# EasyEDA Pro project FOX_HTOL_1.0.eprj, board PCB1 (continued)
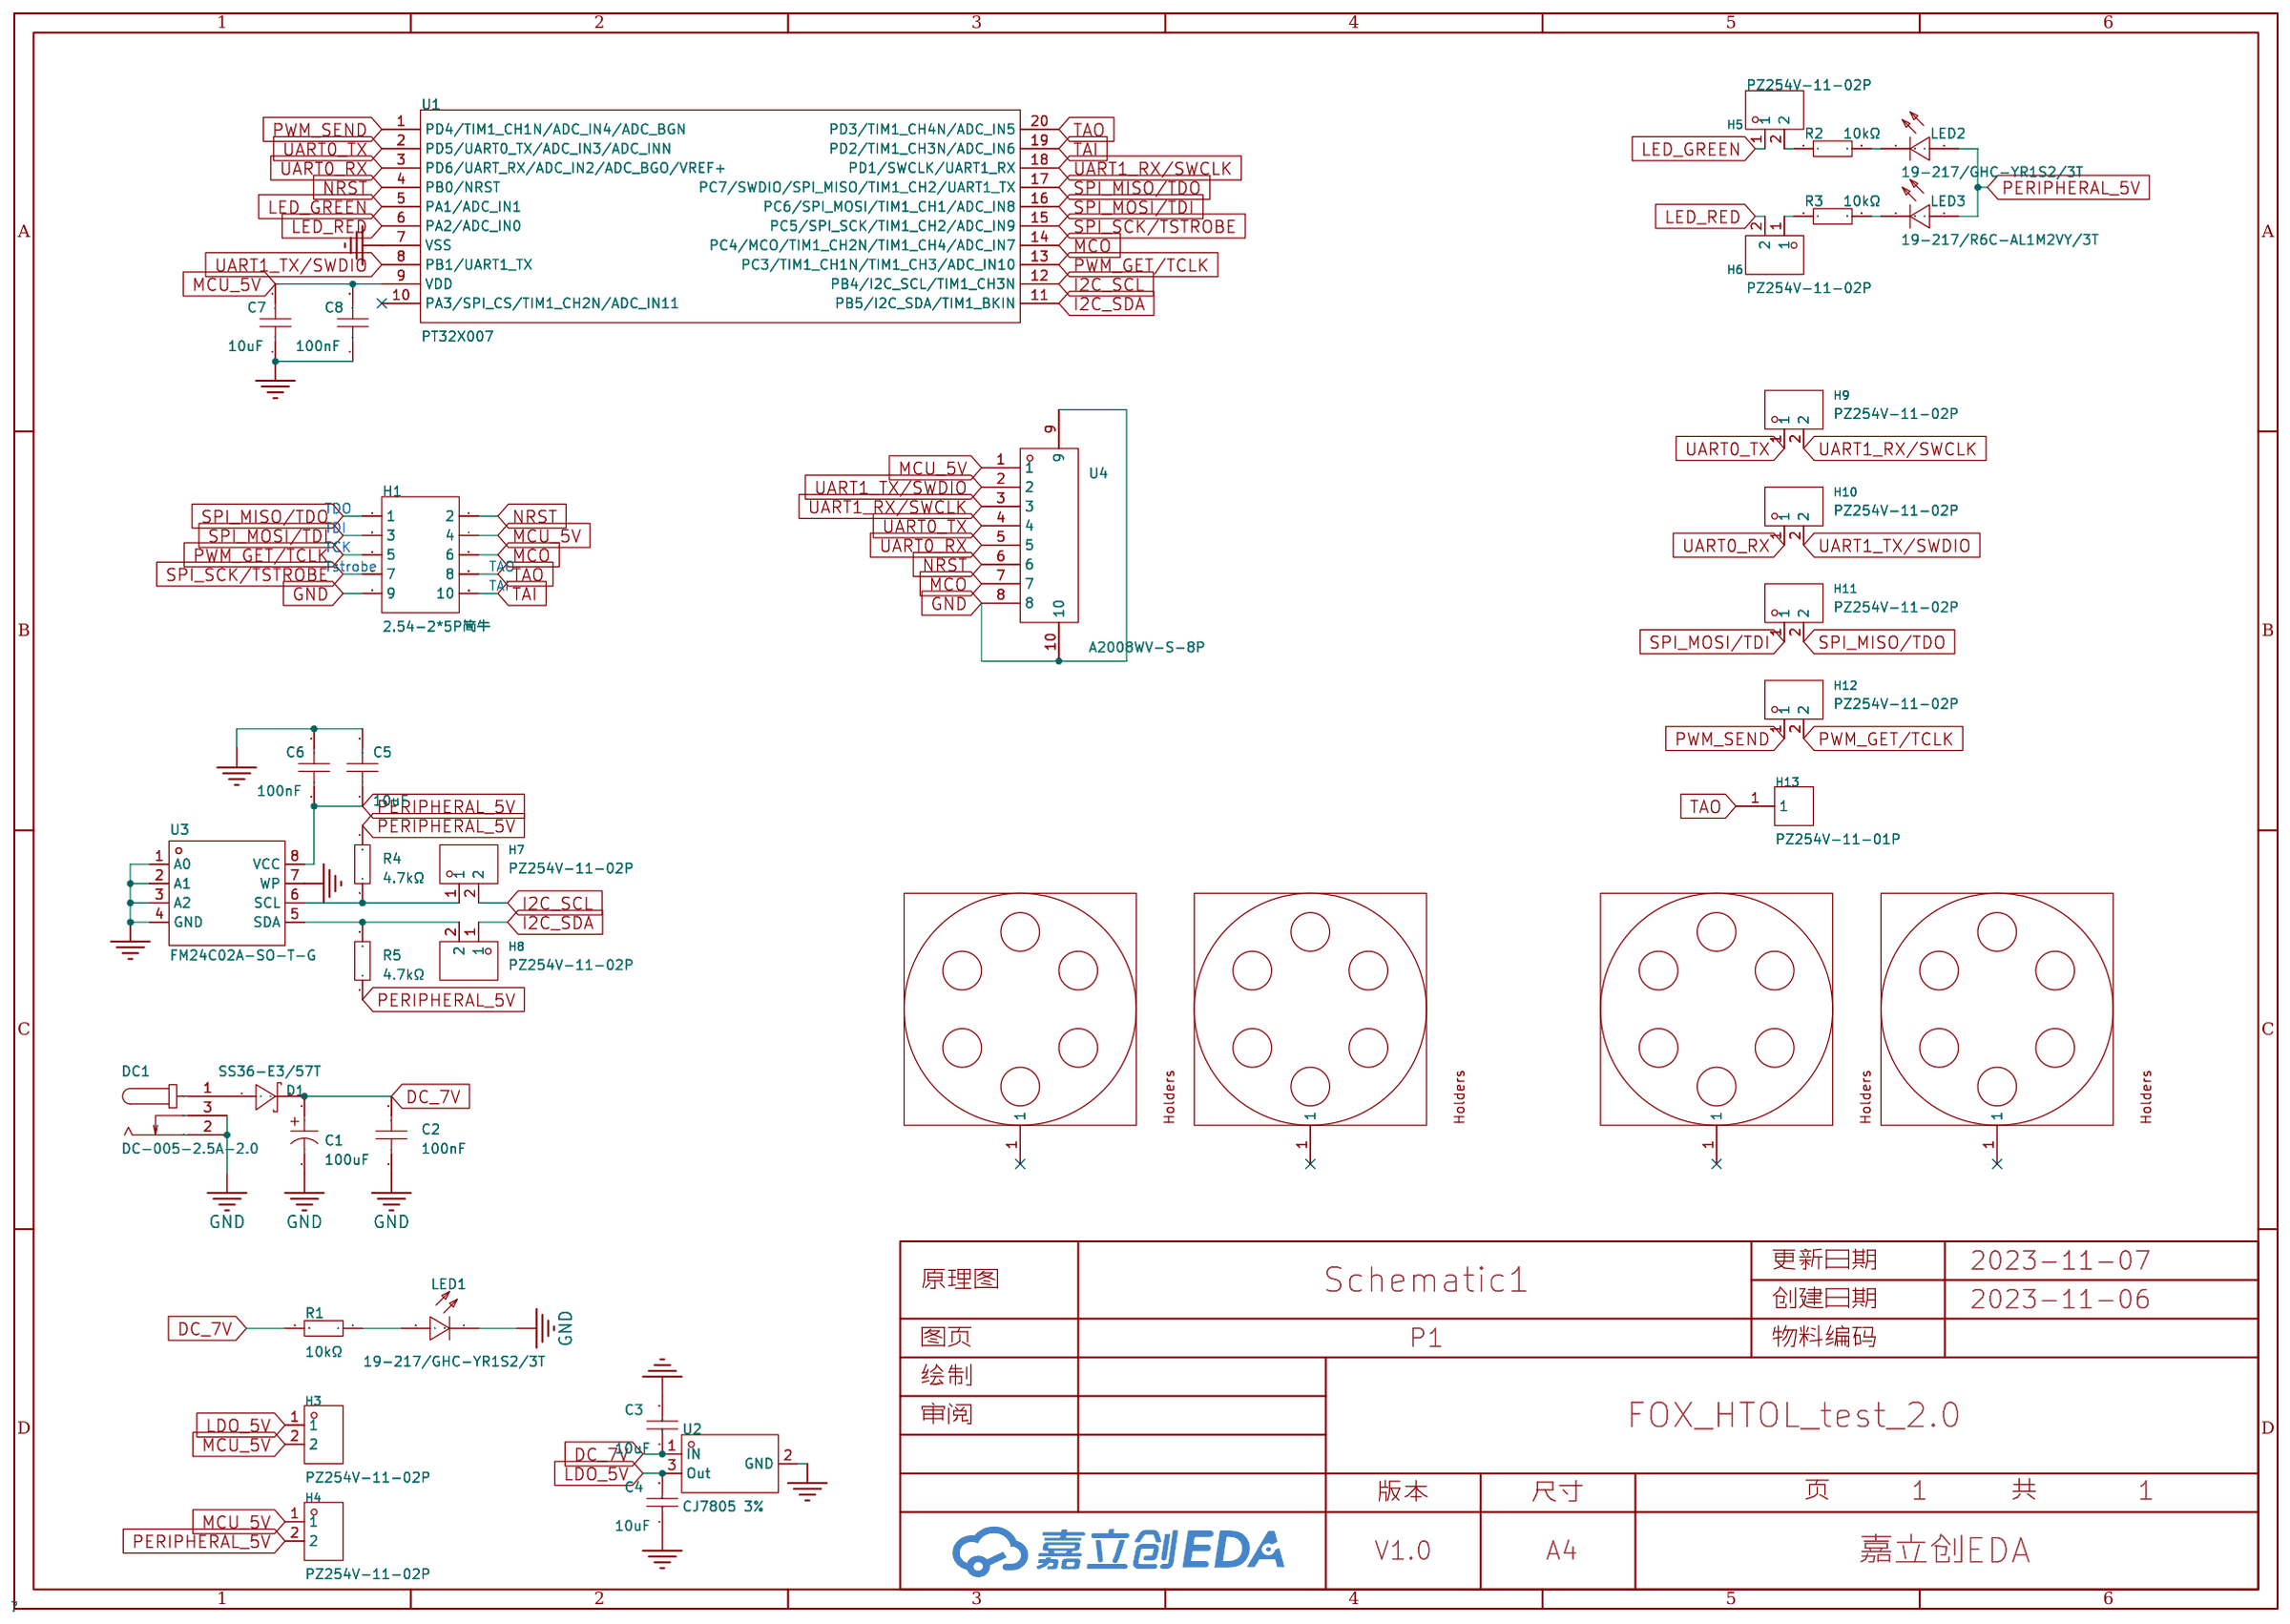
[diagram p0: schematic sheet]
## Routing (per net, layer and track width the routed paths; a pad name or vN(x,y) marks a point on that pad's centre or on a via; arc(x,y) is an arc through that point) (continued)
SPI_SCK/TSTROBE: length 354
  Top Layer w0.254: H1#16.7 21.56,157.47 21.56,152.19 22.3,151.46 U1#18.15 ; H1#6.7 98.4,189.6 98.4,184.32 99.13,183.58 U1#8.15 ; H1#4.7 98.4,253.85 98.4,248.56 99.13,247.83 U1#7.15 ; U1#26.15 60.71,22.96 59.98,23.69 59.98,28.98 H1#23.7 ; H1.7 98.4,93.23 98.4,87.94 99.13,87.21 U1#6.15 ; U1#13.15 137.54,215.71 136.81,216.44 136.81,221.72 H1#12.7 ; U1#5.15 99.13,215.71 98.4,216.44 98.4,221.72 H1#5.7 ; H1#11.7 136.81,253.85 136.81,248.56 137.54,247.83 U1#15.15 ; H1#26.7 59.98,253.85 59.98,248.56 60.71,247.83 U1#29.15 ; U1#14.15 137.54,87.21 136.81,87.94 136.81,93.23 H1#15.7 ; H1#7.7 98.4,157.47 98.4,152.19 99.13,151.46 U1#9.15 ; U1#12.15 137.54,22.96 136.81,23.69 136.81,28.98 H1#9.7 ; U1#23.15 22.3,215.71 21.56,216.44 21.56,221.72 H1#21.7 ; U1#3.15 99.13,55.09 98.4,55.82 98.4,61.1 H1#32.7 ; H1#10.7 136.81,125.35 136.81,120.07 137.54,119.33 139.2,119.33 ; U1#16.15 137.54,183.58 136.81,184.32 136.81,189.6 H1#13.7 ; H1#14.7 136.81,157.47 136.81,152.19 137.54,151.46 U1#17.15 ; U1#30.15 60.71,183.58 59.98,184.32 59.98,189.6 H1#28.7 ; H1#17.7 21.56,28.98 21.56,23.69 22.3,22.96 U1#19.15 ; U1#27.15 60.71,215.71 59.98,216.44 59.98,221.72 H1#27.7 ; U1#28.15 60.71,87.21 59.98,87.94 59.98,93.23 H1#30.7 ; U1#4.15 99.13,22.96 98.4,23.69 98.4,28.98 H1#2.7 ; H1#25.7 21.56,253.85 21.56,248.56 22.3,247.83 U1.15 ; U1#32.15 60.71,151.46 59.98,152.19 59.98,157.47 H1#29.7 ; U1#21.15 22.3,55.09 21.56,55.82 21.56,61.1 H1#19.7 ; H1#24.7 59.98,125.35 59.98,120.07 60.71,119.33 62.37,119.33 ; H1#22.7 59.98,61.1 59.98,55.82 60.71,55.09 U1#25.15 ; H1#8.7 136.81,61.1 136.81,55.82 137.54,55.09 U1#11.15 ; H1#3.7 98.4,125.35 98.4,120.07 99.13,119.33 100.78,119.33 ; H1#20.7 21.56,125.35 21.56,120.07 22.3,119.33 23.95,119.33 ; H1#31.7 21.56,189.6 21.56,184.32 22.3,183.58 U1#31.15 ; H1#18.7 21.56,93.23 21.56,87.94 22.3,87.21 U1#20.15
TAI: length 687.1
  Top Layer w0.254: U1#2.19 103,121.94 104.77,120.17 106.8,120.17 108.71,122.07 108.71,127.41 106.04,130.07 H1#3.10 ; H1#26.10 67.63,258.57 70.29,255.9 70.29,250.57 68.39,248.67 66.36,248.67 64.59,250.43 U1#29.19 ; H1#2.10 106.04,33.7 108.71,31.03 108.71,25.7 106.8,23.79 104.77,23.79 103,25.56 U1#4.19 ; U1#5.19 103,218.31 104.77,216.54 106.8,216.54 108.71,218.45 108.71,223.78 106.04,226.45 H1#5.10 ; H1#29.10 67.63,162.2 70.29,159.53 70.29,154.2 68.39,152.29 66.36,152.29 64.59,154.06 U1#32.19 ; H1#14.10 144.46,162.2 147.12,159.53 147.12,154.2 145.22,152.29 143.19,152.29 141.42,154.06 U1#17.19 ; H1#27.10 67.63,226.45 70.29,223.78 70.29,218.45 68.39,216.54 66.36,216.54 64.59,218.31 U1#27.19 ; U1.19 26.17,250.43 27.94,248.67 29.97,248.67 31.88,250.57 31.88,255.9 29.21,258.57 H1#25.10 ; H1#20.10 29.21,130.07 31.88,127.41 31.88,122.07 29.97,120.17 27.94,120.17 26.17,121.94 U1#22.19 ; H1#19.10 29.21,65.83 31.88,63.16 31.88,57.82 29.97,55.92 27.94,55.92 26.17,57.69 U1#21.19 ; H1#17.10 29.21,33.7 31.88,31.03 31.88,25.7 29.97,23.79 27.94,23.79 26.17,25.56 U1#19.19 ; H1#24.10 67.63,130.07 70.29,127.41 70.29,122.07 68.39,120.17 66.36,120.17 64.59,121.94 U1#24.19 ; U1#13.19 141.42,218.31 143.19,216.54 145.22,216.54 147.12,218.45 147.12,223.78 144.46,226.45 H1#12.10 ; U1#23.19 26.17,218.31 27.94,216.54 29.97,216.54 31.88,218.45 31.88,223.78 29.21,226.45 H1#21.10 ; 26.29,194.32 29.21,194.32 31.88,191.66 31.88,186.32 29.97,184.42 27.94,184.42 26.17,186.18 U1#31.19 ; U1#15.19 141.42,250.43 143.19,248.67 145.22,248.67 147.12,250.57 147.12,255.9 144.46,258.57 H1#11.10 ; 103.12,194.32 106.04,194.32 108.71,191.66 108.71,186.32 106.8,184.42 104.77,184.42 103,186.18 U1#8.19 ; U1#20.19 26.17,89.81 27.94,88.04 29.97,88.04 31.88,89.95 31.88,95.28 29.21,97.95 H1#18.10 ; U1#16.19 141.42,186.18 143.19,184.42 145.22,184.42 147.12,186.32 147.12,191.66 144.46,194.32 141.54,194.32 ; U1#28.19 64.59,89.81 66.36,88.04 68.39,88.04 70.29,89.95 70.29,95.28 67.63,97.95 H1#30.10 ; U1#9.19 103,154.06 104.77,152.29 106.8,152.29 108.71,154.2 108.71,159.53 106.04,162.2 H1#7.10 ; U1#18.19 26.17,154.06 27.94,152.29 29.97,152.29 31.88,154.2 31.88,159.53 29.21,162.2 H1#16.10 ; H1#32.10 106.04,65.83 108.71,63.16 108.71,57.82 106.8,55.92 104.77,55.92 103,57.69 U1#3.19 ; U1#10.19 141.42,121.94 143.19,120.17 145.22,120.17 147.12,122.07 147.12,127.41 144.46,130.07 H1#10.10 ; H1#9.10 144.46,33.7 147.12,31.03 147.12,25.7 145.22,23.79 143.19,23.79 141.42,25.56 U1#12.19 ; U1#11.19 141.42,57.69 143.19,55.92 145.22,55.92 147.12,57.82 147.12,63.16 144.46,65.83 H1#8.10 ; H1#23.10 67.63,33.7 70.29,31.03 70.29,25.7 68.39,23.79 66.36,23.79 64.59,25.56 U1#26.19 ; H1.10 106.04,97.95 108.71,95.28 108.71,89.95 106.8,88.04 104.77,88.04 103,89.81 U1#6.19 ; U1#14.19 141.42,89.81 143.19,88.04 145.22,88.04 147.12,89.95 147.12,95.28 144.46,97.95 H1#15.10 ; U1#7.19 103,250.43 104.77,248.67 106.8,248.67 108.71,250.57 108.71,255.9 106.04,258.57 H1#4.10 ; U1#25.19 64.59,57.69 66.36,55.92 68.39,55.92 70.29,57.82 70.29,63.16 67.63,65.83 H1#22.10 ; U1#30.19 64.59,186.18 66.36,184.42 68.39,184.42 70.29,186.32 70.29,191.66 67.63,194.32 64.71,194.32
TAO: length 613.9
  Top Layer w0.254: U1#20.20 28.7,90.46 H13#20.1 30.35,89.95 30.86,90.46 30.86,93.25 27.43,96.68 25.02,96.68 H1#18.8 ; U1#29.20 67.11,251.08 H13#27.1 68.77,250.57 69.28,251.08 69.28,253.87 65.85,257.3 63.44,257.3 H1#26.8 ; U1#14.20 143.95,90.46 H13#17.1 145.6,89.95 146.11,90.46 146.11,93.25 142.68,96.68 140.27,96.68 H1#15.8 ; H1#3.8 101.85,128.8 104.26,128.8 107.69,125.38 107.69,122.58 107.19,122.07 H13.1 105.53,122.59 U1#2.20 ; H1#21.8 25.02,225.18 27.43,225.18 30.86,221.75 30.86,218.95 30.35,218.45 H13#24.1 28.7,218.96 U1#23.20 ; H1#16.8 25.02,160.93 27.43,160.93 30.86,157.5 30.86,154.71 30.35,154.2 H13#18.1 28.7,154.71 U1#18.20 ; H1#7.8 101.85,160.93 104.26,160.93 107.69,157.5 107.69,154.71 107.19,154.2 H13#6.1 105.53,154.71 U1#9.20 ; U1#31.20 28.7,186.83 H13#15.1 30.35,186.32 30.86,186.83 30.86,189.62 27.43,193.05 25.02,193.05 23.75,194.32 ; H1.8 101.85,96.68 104.26,96.68 107.69,93.25 107.69,90.46 107.19,89.95 H13#8.1 105.53,90.46 U1#6.20 ; U1#7.20 105.53,251.08 H13#4.1 107.19,250.57 107.69,251.08 107.69,253.87 104.26,257.3 101.85,257.3 H1#4.8 ; 100.58,194.32 101.85,193.05 104.26,193.05 107.69,189.62 107.69,186.83 107.19,186.32 H13#7.1 105.53,186.83 U1#8.20 ; H1#10.8 140.27,128.8 142.68,128.8 146.11,125.38 146.11,122.58 145.6,122.07 H13#9.1 143.95,122.59 U1#10.20 ; U1#3.20 105.53,58.34 H13#2.1 107.19,57.82 107.69,58.33 107.69,61.13 104.26,64.56 101.85,64.56 H1#32.8 ; H1#8.8 140.27,64.56 142.68,64.56 146.11,61.13 146.11,58.33 145.6,57.82 H13#10.1 143.95,58.34 U1#11.20 ; U1#21.20 28.7,58.34 H13#21.1 30.35,57.82 30.86,58.33 30.86,61.13 27.43,64.56 25.02,64.56 H1#19.8 ; H1#29.8 63.44,160.93 65.85,160.93 69.28,157.5 69.28,154.71 68.77,154.2 H13#29.1 67.11,154.71 U1#32.20 ; U1#16.20 143.95,186.83 H13#16.1 145.6,186.32 146.11,186.83 146.11,189.62 142.68,193.05 140.27,193.05 139,194.32 ; U1#5.20 105.53,218.96 H13#5.1 107.19,218.45 107.69,218.95 107.69,221.75 104.26,225.18 101.85,225.18 H1#5.8 ; U1#13.20 143.95,218.96 H13#13.1 145.6,218.45 146.11,218.95 146.11,221.75 142.68,225.18 140.27,225.18 H1#12.8 ; H1#14.8 140.27,160.93 142.68,160.93 146.11,157.5 146.11,154.71 145.6,154.2 H13#14.1 143.95,154.71 U1#17.20 ; U1#25.20 67.11,58.34 H13#25.1 68.77,57.82 69.28,58.33 69.28,61.13 65.85,64.56 63.44,64.56 H1#22.8 ; H1#11.8 140.27,257.3 142.68,257.3 146.11,253.87 146.11,251.08 145.6,250.57 H13#12.1 143.95,251.08 U1#15.20 ; 62.16,194.32 63.44,193.05 65.85,193.05 69.28,189.62 69.28,186.83 68.77,186.32 H13#31.1 67.11,186.83 U1#30.20 ; U1#24.20 67.11,122.59 H13#23.1 68.77,122.07 69.28,122.58 69.28,125.38 65.85,128.8 63.44,128.8 H1#24.8 ; U1#26.20 67.11,26.21 H13#26.1 68.77,25.7 69.28,26.21 69.28,29 65.85,32.43 63.44,32.43 H1#23.8 ; H1#30.8 63.44,96.68 65.85,96.68 69.28,93.25 69.28,90.46 68.77,89.95 H13#32.1 67.11,90.46 U1#28.20 ; U1#19.20 28.7,26.21 H13#19.1 30.35,25.7 30.86,26.21 30.86,29 27.43,32.43 25.02,32.43 H1#17.8 ; H1#25.8 25.02,257.3 27.43,257.3 30.86,253.87 30.86,251.08 30.35,250.57 H13#30.1 28.7,251.08 U1.20 ; U1#22.20 28.7,122.59 H13#22.1 30.35,122.07 30.86,122.58 30.86,125.38 27.43,128.8 25.02,128.8 H1#20.8 ; U1#12.20 143.95,26.21 H13#11.1 145.6,25.7 146.11,26.21 146.11,29 142.68,32.43 140.27,32.43 H1#9.8 ; U1#4.20 105.53,26.21 H13#3.1 107.19,25.7 107.69,26.21 107.69,29 104.26,32.43 101.85,32.43 H1#2.8 ; H1#27.8 63.44,225.18 65.85,225.18 69.28,221.75 69.28,218.95 68.77,218.45 H13#28.1 67.11,218.96 U1#27.20
UART0_RX: length 1196.7
  Top Layer w0.254: U4#3.5 v1(115.4,25.7) 115.44,25.7 ; v2(96.77,151.53) 96.77,152.77 96.14,153.41 U1#9.3 89.05,153.41 88.39,154.07 88.39,158.26 87.75,158.9 H10#4.1 ; v2(135.19,247.9) 135.19,249.15 134.55,249.78 U1#15.3 127.47,249.78 126.8,250.44 126.8,254.63 126.17,255.27 H10#11.1 ; U4#26.5 v1(76.99,25.7) 77.02,25.7 ; U4#15.5 v1(153.82,250.57) 153.86,250.57 ; v2(96.77,23.03) 96.77,24.28 96.14,24.91 U1#4.3 89.05,24.91 88.39,25.57 88.39,29.76 87.75,30.4 H10#6.1 ; 38.61,122.07 v1(38.57,122.07) U4#23.5 ; v2(58.36,23.03) 58.36,24.28 57.72,24.91 U1#26.3 50.63,24.91 49.97,25.57 49.97,29.76 49.34,30.4 H10#30.1 ; 115.44,250.57 v1(115.4,250.57) U4#6.5 ; H10#10.1 126.17,126.77 126.8,126.14 126.8,121.95 127.47,121.29 U1#10.3 134.55,121.29 135.19,120.65 v2(135.19,119.41) ; 38.61,89.95 v1(38.57,89.95) U4#22.5 ; 115.44,154.2 v1(115.4,154.2) U4#5.5 ; 77.02,122.07 v1(76.99,122.07) U4#32.5 ; H10#12.1 126.17,223.15 126.8,222.51 126.8,218.32 127.47,217.66 U1#13.3 134.55,217.66 135.19,217.02 v2(135.19,215.78) ; v2(135.19,87.28) 135.19,88.53 134.55,89.16 U1#14.3 127.47,89.16 126.8,89.82 126.8,94.01 126.17,94.65 H10#17.1 ; H10#9.1 10.92,255.27 11.56,254.63 11.56,250.44 12.22,249.78 U1.3 19.3,249.78 19.94,249.15 v2(19.94,247.9) ; H10#18.1 10.92,191.02 11.56,190.39 11.56,186.19 12.22,185.53 U1#31.3 19.3,185.53 19.94,184.9 v2(19.94,183.65) ; v2(96.77,215.78) 96.77,217.02 96.14,217.66 U1#5.3 89.05,217.66 88.39,218.32 88.39,222.51 87.75,223.15 H10#3.1 ; H10#27.1 10.92,223.15 11.56,222.51 11.56,218.32 12.22,217.66 U1#23.3 19.3,217.66 19.94,217.02 v2(19.94,215.78) ; v2(96.77,87.28) 96.77,88.53 96.14,89.16 U1#6.3 89.05,89.16 88.39,89.82 88.39,94.01 87.75,94.65 H10#8.1 ; v2(58.36,151.53) 58.36,152.77 57.72,153.41 U1#32.3 50.63,153.41 49.97,154.07 49.97,158.26 49.34,158.9 H10#28.1 ; 153.86,186.32 v1(153.82,186.32) U4#13.5 ; v2(96.77,119.41) 96.77,120.65 96.14,121.29 U1#2.3 89.05,121.29 88.39,121.95 88.39,126.14 87.75,126.77 H10.1 ; 115.44,89.95 v1(115.4,89.95) U4.5 ; 115.44,122.07 v1(115.4,122.07) U4#8.5 ; v2(58.36,87.28) 58.36,88.53 57.72,89.16 U1#28.3 50.63,89.16 49.97,89.82 49.97,94.01 49.34,94.65 H10#32.1 ; 153.86,122.07 v1(153.82,122.07) U4#17.5 ; H10#31.1 49.34,191.02 49.97,190.39 49.97,186.19 50.63,185.53 U1#30.3 57.72,185.53 58.36,184.9 v2(58.36,183.65) ; 115.44,218.45 v1(115.4,218.45) U4#7.5 ; 153.86,57.82 v1(153.82,57.82) U4#11.5 ; H10#14.1 126.17,62.52 126.8,61.89 126.8,57.7 127.47,57.04 U1#11.3 134.55,57.04 135.19,56.4 v2(135.19,55.16) ; U4#28.5 v1(76.99,154.2) 77.02,154.2 ; 115.44,186.32 v1(115.4,186.32) U4#4.5 ; U4#12.5 v1(153.82,25.7) 153.86,25.7 ; U4#18.5 v1(38.57,186.32) 38.61,186.32 ; H10#2.1 87.75,255.27 88.39,254.63 88.39,250.44 89.05,249.78 U1#7.3 96.14,249.78 96.77,249.15 v2(96.77,247.9) ; v2(19.94,23.03) 19.94,24.28 19.3,24.91 U1#19.3 12.22,24.91 11.56,25.57 11.56,29.76 10.92,30.4 H10#20.1 ; 38.61,25.7 v1(38.57,25.7) U4#20.5 ; U4#16.5 v1(153.82,218.45) 153.86,218.45 ; U4#27.5 v1(76.99,186.32) 77.02,186.32 ; H10#23.1 10.92,126.77 11.56,126.14 11.56,121.95 12.22,121.29 U1#22.3 19.3,121.29 19.94,120.65 v2(19.94,119.41) ; 115.44,57.82 v1(115.4,57.82) U4#2.5 ; v2(58.36,119.41) 58.36,120.65 57.72,121.29 U1#24.3 50.63,121.29 49.97,121.95 49.97,126.14 49.34,126.77 H10#24.1 ; v2(96.77,183.65) 96.77,184.9 96.14,185.53 U1#8.3 89.05,185.53 88.39,186.19 88.39,190.39 87.75,191.02 H10#7.1 ; 153.86,89.95 v1(153.82,89.95) U4#10.5 ; 77.02,218.45 v1(76.99,218.45) U4#30.5 ; U4#29.5 v1(76.99,250.57) 77.02,250.57 ; H10#13.1 126.17,158.9 126.8,158.26 126.8,154.07 127.47,153.41 U1#17.3 134.55,153.41 135.19,152.77 v2(135.19,151.53) ; H10#25.1 49.34,255.27 49.97,254.63 49.97,250.44 50.63,249.78 U1#29.3 57.72,249.78 58.36,249.15 v2(58.36,247.9) ; 77.02,57.82 v1(76.99,57.82) U4#25.5 ; 153.86,154.2 v1(153.82,154.2) U4#14.5 ; H10#19.1 10.92,158.9 11.56,158.26 11.56,154.07 12.22,153.41 U1#18.3 19.3,153.41 19.94,152.77 v2(19.94,151.53) ; H10#15.1 126.17,30.4 126.8,29.76 126.8,25.57 127.47,24.91 U1#12.3 134.55,24.91 135.19,24.28 v2(135.19,23.03) ; v2(19.94,55.16) 19.94,56.4 19.3,57.04 U1#21.3 12.22,57.04 11.56,57.7 11.56,61.89 10.92,62.52 H10#22.1 ; 38.61,57.82 v1(38.57,57.82) U4#21.5 ; H10#5.1 87.75,62.52 88.39,61.89 88.39,57.7 89.05,57.04 U1#3.3 96.14,57.04 96.77,56.4 v2(96.77,55.16) ; 38.61,218.45 v1(38.57,218.45) U4#31.5 ; v2(58.36,215.78) 58.36,217.02 57.72,217.66 U1#27.3 50.63,217.66 49.97,218.32 49.97,222.51 49.34,223.15 H10#26.1 ; U4#19.5 v1(38.57,154.2) 38.61,154.2 ; H10#16.1 126.17,191.02 126.8,190.39 126.8,186.19 127.47,185.53 U1#16.3 134.55,185.53 135.19,184.9 v2(135.19,183.65) ; H10#21.1 10.92,94.65 11.56,94.01 11.56,89.82 12.22,89.16 U1#20.3 19.3,89.16 19.94,88.53 v2(19.94,87.28) ; 38.61,250.57 v1(38.57,250.57) U4#9.5 ; v2(58.36,55.16) 58.36,56.4 57.72,57.04 U1#25.3 50.63,57.04 49.97,57.7 49.97,61.89 49.34,62.52 H10#29.1 ; U4#24.5 v1(76.99,89.95) 77.02,89.95
  Bottom Layer w0.254: v2(19.94,119.41) 20.32,119.03 31.12,119.03 34.16,122.07 v1(38.57,122.07) ; v1(76.99,250.57) 72.58,250.57 69.53,247.52 58.74,247.52 v2(58.36,247.9) ; v1(76.99,122.07) 72.58,122.07 69.53,119.03 58.74,119.03 v2(58.36,119.41) ; v2(58.36,183.65) 58.74,183.27 69.53,183.27 72.58,186.32 v1(76.99,186.32) ; v1(153.82,250.57) 149.41,250.57 146.36,247.52 135.57,247.52 v2(135.19,247.9) ; v2(96.77,215.78) 97.15,215.4 107.95,215.4 111,218.45 v1(115.4,218.45) ; v2(58.36,55.16) 58.74,54.78 69.53,54.78 72.58,57.82 v1(76.99,57.82) ; v2(96.77,23.03) 97.15,22.65 107.95,22.65 111,25.7 v1(115.4,25.7) ; v2(96.77,55.16) 97.15,54.78 107.95,54.78 111,57.82 v1(115.4,57.82) ; v1(153.82,89.95) 149.41,89.95 146.36,86.9 135.57,86.9 v2(135.19,87.28) ; v2(19.94,151.53) 20.32,151.15 31.12,151.15 34.16,154.2 v1(38.57,154.2) ; v1(76.99,89.95) 72.58,89.95 69.53,86.9 58.74,86.9 v2(58.36,87.28) ; v1(38.57,25.7) 34.16,25.7 31.12,22.65 20.32,22.65 v2(19.94,23.03) ; v1(115.4,122.07) 111,122.07 107.95,119.03 97.15,119.03 v2(96.77,119.41) ; v2(135.19,183.65) 135.57,183.27 146.36,183.27 149.41,186.32 v1(153.82,186.32) ; v1(38.57,57.82) 34.16,57.82 31.12,54.78 20.32,54.78 v2(19.94,55.16) ; v2(96.77,183.65) 97.15,183.27 107.95,183.27 111,186.32 v1(115.4,186.32) ; v1(38.57,186.32) 34.16,186.32 31.12,183.27 20.32,183.27 v2(19.94,183.65) ; v2(19.94,87.28) 20.32,86.9 31.12,86.9 34.16,89.95 v1(38.57,89.95) ; v2(96.77,87.28) 97.15,86.9 107.95,86.9 111,89.95 v1(115.4,89.95) ; v2(58.36,151.53) 58.74,151.15 69.53,151.15 72.58,154.2 v1(76.99,154.2) ; v1(153.82,122.07) 149.41,122.07 146.36,119.03 135.57,119.03 v2(135.19,119.41) ; v1(38.57,250.57) 34.16,250.57 31.12,247.52 20.32,247.52 v2(19.94,247.9) ; v2(19.94,215.78) 20.32,215.4 31.12,215.4 34.16,218.45 v1(38.57,218.45) ; v2(135.19,23.03) 135.57,22.65 146.36,22.65 149.41,25.7 v1(153.82,25.7) ; v2(96.77,151.53) 97.15,151.15 107.95,151.15 111,154.2 v1(115.4,154.2) ; v1(153.82,57.82) 149.41,57.82 146.36,54.78 135.57,54.78 v2(135.19,55.16) ; v2(96.77,247.9) 97.15,247.52 107.95,247.52 111,250.57 v1(115.4,250.57) ; v2(135.19,151.53) 135.57,151.15 146.36,151.15 149.41,154.2 v1(153.82,154.2) ; v2(135.19,215.78) 135.57,215.4 146.36,215.4 149.41,218.45 v1(153.82,218.45) ; v1(76.99,25.7) 72.58,25.7 69.53,22.65 58.74,22.65 v2(58.36,23.03) ; v2(58.36,215.78) 58.74,215.4 69.53,215.4 72.58,218.45 v1(76.99,218.45)
UART0_TX: length 1278.6
  Top Layer w0.254: v1(76.97,91.96) 76.99,91.98 77.02,91.98 ; H9#14.1 126.93,161.44 127.41,160.95 127.41,154.6 127.95,154.07 133.45,154.07 U1#17.2 134.8,154.06 v2(134.81,154.07) ; 38.61,156.23 38.57,156.23 v1(38.55,156.21) ; v2(19.56,250.44) 19.55,250.43 U1.2 18.2,250.44 12.7,250.44 12.17,250.98 12.17,257.33 11.68,257.81 H9#10.1 ; v1(115.39,91.96) 115.4,91.98 115.44,91.98 ; v1(153.8,124.09) 153.82,124.11 153.86,124.11 ; v1(115.39,252.59) 115.4,252.6 115.44,252.6 ; v1(115.39,188.34) 115.4,188.35 115.44,188.35 ; v1(38.55,91.96) 38.57,91.98 38.61,91.98 ; 77.02,156.23 76.99,156.23 v1(76.97,156.21) ; 77.02,252.6 76.99,252.6 v1(76.97,252.59) ; 77.02,188.35 76.99,188.35 v1(76.97,188.34) ; v1(115.39,59.84) 115.4,59.86 115.44,59.86 ; H9#12.1 126.93,225.69 127.41,225.2 127.41,218.85 127.95,218.32 133.45,218.32 U1#13.2 134.8,218.31 v2(134.81,218.32) ; 153.86,156.23 153.82,156.23 v1(153.8,156.21) ; v1(115.39,220.46) 115.4,220.48 115.44,220.48 ; v2(57.97,218.32) 57.96,218.31 U1#27.2 56.62,218.32 51.12,218.32 50.58,218.85 50.58,225.2 50.1,225.69 H9#25.1 ; 38.61,124.11 38.57,124.11 v1(38.55,124.09) ; H9#20.1 11.68,32.94 12.17,32.46 12.17,26.11 12.7,25.57 18.2,25.57 U1#19.2 19.55,25.56 v2(19.56,25.57) ; v1(38.55,59.84) 38.57,59.86 38.61,59.86 ; v2(96.39,218.32) 96.38,218.31 U1#5.2 95.03,218.32 89.53,218.32 89,218.85 89,225.2 88.52,225.69 H9#3.1 ; v2(96.39,57.7) 96.38,57.69 U1#3.2 95.03,57.7 89.53,57.7 89,58.23 89,64.58 88.52,65.06 H9#8.1 ; v2(96.39,250.44) 96.38,250.43 U1#7.2 95.03,250.44 89.53,250.44 89,250.98 89,257.33 88.52,257.81 H9#5.1 ; 153.86,27.73 153.82,27.73 v1(153.8,27.72) ; v2(57.97,154.07) 57.96,154.06 U1#32.2 56.62,154.07 51.12,154.07 50.58,154.6 50.58,160.95 50.1,161.44 H9#29.1 ; 153.86,188.35 153.82,188.35 v1(153.8,188.34) ; H9.1 126.93,32.94 127.41,32.46 127.41,26.11 127.95,25.57 133.45,25.57 U1#12.2 134.8,25.56 v2(134.81,25.57) ; v2(96.39,121.95) 96.38,121.94 U1#2.2 95.03,121.95 89.53,121.95 89,122.48 89,128.83 88.52,129.31 H9#2.1 ; 38.61,252.6 38.57,252.6 v1(38.55,252.59) ; v2(57.97,25.57) 57.96,25.56 U1#26.2 56.62,25.57 51.12,25.57 50.58,26.11 50.58,32.46 50.1,32.94 H9#26.1 ; v1(76.97,59.84) 76.99,59.86 77.02,59.86 ; v1(76.97,124.09) 76.99,124.11 77.02,124.11 ; H9#11.1 126.93,129.31 127.41,128.83 127.41,122.48 127.95,121.95 133.45,121.95 U1#10.2 134.8,121.94 v2(134.81,121.95) ; v1(115.39,124.09) 115.4,124.11 115.44,124.11 ; H9#17.1 126.93,193.56 127.41,193.08 127.41,186.73 127.95,186.19 133.45,186.19 U1#16.2 134.8,186.18 v2(134.81,186.19) ; v1(76.97,27.72) 76.99,27.73 77.02,27.73 ; v1(115.39,156.21) 115.4,156.23 115.44,156.23 ; v1(153.8,220.46) 153.82,220.48 153.86,220.48 ; 38.61,220.48 38.57,220.48 v1(38.55,220.46) ; v2(57.97,89.82) 57.96,89.81 U1#28.2 56.62,89.82 51.12,89.82 50.58,90.36 50.58,96.71 50.1,97.19 H9#30.1 ; v1(38.55,188.34) 38.57,188.35 38.61,188.35 ; 77.02,220.48 76.99,220.48 v1(76.97,220.46) ; H9#13.1 126.93,257.81 127.41,257.33 127.41,250.98 127.95,250.44 133.45,250.44 U1#15.2 134.8,250.43 v2(134.81,250.44) ; v1(153.8,252.59) 153.82,252.6 153.86,252.6 ; v2(57.97,186.19) 57.96,186.18 U1#30.2 56.62,186.19 51.12,186.19 50.58,186.73 50.58,193.08 50.1,193.56 H9#32.1 ; H9#31.1 50.1,65.06 50.58,64.58 50.58,58.23 51.12,57.7 56.62,57.7 U1#25.2 57.96,57.69 v2(57.97,57.7) ; v1(115.39,27.72) 115.4,27.73 115.44,27.73 ; v2(96.39,25.57) 96.38,25.56 U1#4.2 95.03,25.57 89.53,25.57 89,26.11 89,32.46 88.52,32.94 H9#4.1 ; v1(38.55,27.72) 38.57,27.73 38.61,27.73 ; v2(57.97,250.44) 57.96,250.43 U1#29.2 56.62,250.44 51.12,250.44 50.58,250.98 50.58,257.33 50.1,257.81 H9#27.1 ; v1(153.8,91.96) 153.82,91.98 153.86,91.98 ; H9#23.1 11.68,129.31 12.17,128.83 12.17,122.48 12.7,121.95 18.2,121.95 U1#22.2 19.55,121.94 v2(19.56,121.95) ; H9#28.1 11.68,225.69 12.17,225.2 12.17,218.85 12.7,218.32 18.2,218.32 U1#23.2 19.55,218.31 v2(19.56,218.32) ; H9#21.1 11.68,97.19 12.17,96.71 12.17,90.36 12.7,89.82 18.2,89.82 U1#20.2 19.55,89.81 v2(19.56,89.82) ; H9#7.1 88.52,97.19 89,96.71 89,90.36 89.53,89.82 95.03,89.82 U1#6.2 96.38,89.81 v2(96.39,89.82) ; v2(19.56,154.07) 19.55,154.06 U1#18.2 18.2,154.07 12.7,154.07 12.17,154.6 12.17,160.95 11.68,161.44 H9#19.1 ; H9#15.1 126.93,97.19 127.41,96.71 127.41,90.36 127.95,89.82 133.45,89.82 U1#14.2 134.8,89.81 v2(134.81,89.82) ; H9#18.1 11.68,193.56 12.17,193.08 12.17,186.73 12.7,186.19 18.2,186.19 U1#31.2 19.55,186.18 v2(19.56,186.19) ; v2(96.39,154.07) 96.38,154.06 U1#9.2 95.03,154.07 89.53,154.07 89,154.6 89,160.95 88.52,161.44 H9#6.1 ; H9#24.1 50.1,129.31 50.58,128.83 50.58,122.48 51.12,121.95 56.62,121.95 U1#24.2 57.96,121.94 v2(57.97,121.95) ; v2(96.39,186.19) 96.38,186.18 U1#8.2 95.03,186.19 89.53,186.19 89,186.73 89,193.08 88.52,193.56 H9#9.1 ; v2(134.81,57.7) 134.8,57.69 U1#11.2 133.45,57.7 127.95,57.7 127.41,58.23 127.41,64.58 126.93,65.06 H9#16.1 ; H9#22.1 11.68,65.06 12.17,64.58 12.17,58.23 12.7,57.7 18.2,57.7 U1#21.2 19.55,57.69 v2(19.56,57.7) ; 153.86,59.86 153.82,59.86 v1(153.8,59.84)
  Bottom Layer w0.254: v1(115.39,156.21) 111.74,156.21 107.31,151.78 97.53,151.78 96.39,152.93 v2(96.39,154.07) ; v2(57.97,186.19) 57.97,185.05 59.12,183.91 68.9,183.91 73.33,188.34 v1(76.97,188.34) ; v2(134.81,218.32) 134.81,217.18 135.95,216.03 145.73,216.03 150.16,220.46 v1(153.8,220.46) ; v1(153.8,27.72) 150.16,27.72 145.73,23.29 135.95,23.29 134.81,24.43 v2(134.81,25.57) ; v1(38.55,156.21) 34.91,156.21 30.48,151.78 20.7,151.78 19.56,152.93 v2(19.56,154.07) ; v2(19.56,121.95) 19.56,120.8 20.7,119.66 30.48,119.66 34.91,124.09 v1(38.55,124.09) ; v2(19.56,250.44) 19.56,249.3 20.7,248.16 30.48,248.16 34.91,252.59 v1(38.55,252.59) ; v1(38.55,91.96) 34.91,91.96 30.48,87.54 20.7,87.54 19.56,88.68 v2(19.56,89.82) ; v2(19.56,57.7) 19.56,56.55 20.7,55.41 30.48,55.41 34.91,59.84 v1(38.55,59.84) ; v2(57.97,154.07) 57.97,152.93 59.12,151.78 68.9,151.78 73.33,156.21 v1(76.97,156.21) ; v1(38.55,220.46) 34.91,220.46 30.48,216.03 20.7,216.03 19.56,217.18 v2(19.56,218.32) ; v2(134.81,89.82) 134.81,88.68 135.95,87.54 145.73,87.54 150.16,91.96 v1(153.8,91.96) ; v2(134.81,250.44) 134.81,249.3 135.95,248.16 145.73,248.16 150.16,252.59 v1(153.8,252.59) ; v2(57.97,57.7) 57.97,56.55 59.12,55.41 68.9,55.41 73.33,59.84 v1(76.97,59.84) ; v2(57.97,250.44) 57.97,249.3 59.12,248.16 68.9,248.16 73.33,252.59 v1(76.97,252.59) ; v2(134.81,121.95) 134.81,120.8 135.95,119.66 145.73,119.66 150.16,124.09 v1(153.8,124.09) ; v2(19.56,186.19) 19.56,185.05 20.7,183.91 30.48,183.91 34.91,188.34 v1(38.55,188.34) ; v2(57.97,121.95) 57.97,120.8 59.12,119.66 68.9,119.66 73.33,124.09 v1(76.97,124.09) ; v1(115.39,59.84) 111.74,59.84 107.31,55.41 97.53,55.41 96.39,56.55 v2(96.39,57.7) ; v1(76.97,27.72) 73.33,27.72 68.9,23.29 59.12,23.29 57.97,24.43 v2(57.97,25.57) ; v1(115.39,91.96) 111.74,91.96 107.31,87.54 97.53,87.54 96.39,88.68 v2(96.39,89.82) ; v2(19.56,25.57) 19.56,24.43 20.7,23.29 30.48,23.29 34.91,27.72 v1(38.55,27.72) ; v1(115.39,252.59) 111.74,252.59 107.31,248.16 97.53,248.16 96.39,249.3 v2(96.39,250.44) ; v1(115.39,27.72) 111.74,27.72 107.31,23.29 97.53,23.29 96.39,24.43 v2(96.39,25.57) ; v2(134.81,57.7) 134.81,56.55 135.95,55.41 145.73,55.41 150.16,59.84 v1(153.8,59.84) ; v2(57.97,89.82) 57.97,88.68 59.12,87.54 68.9,87.54 73.33,91.96 v1(76.97,91.96) ; v1(76.97,220.46) 73.33,220.46 68.9,216.03 59.12,216.03 57.97,217.18 v2(57.97,218.32) ; v1(115.39,188.34) 111.74,188.34 107.31,183.91 97.53,183.91 96.39,185.05 v2(96.39,186.19) ; v2(96.39,121.95) 96.39,120.8 97.53,119.66 107.31,119.66 111.74,124.09 v1(115.39,124.09) ; v2(96.39,218.32) 96.39,217.18 97.53,216.03 107.31,216.03 111.74,220.46 v1(115.39,220.46) ; v1(153.8,156.21) 150.16,156.21 145.73,151.78 135.95,151.78 134.81,152.93 v2(134.81,154.07) ; v1(153.8,188.34) 150.16,188.34 145.73,183.91 135.95,183.91 134.81,185.05 v2(134.81,186.19)
